# EasyEDA Pro project Chessboards.epro, board Diagonal (continued)
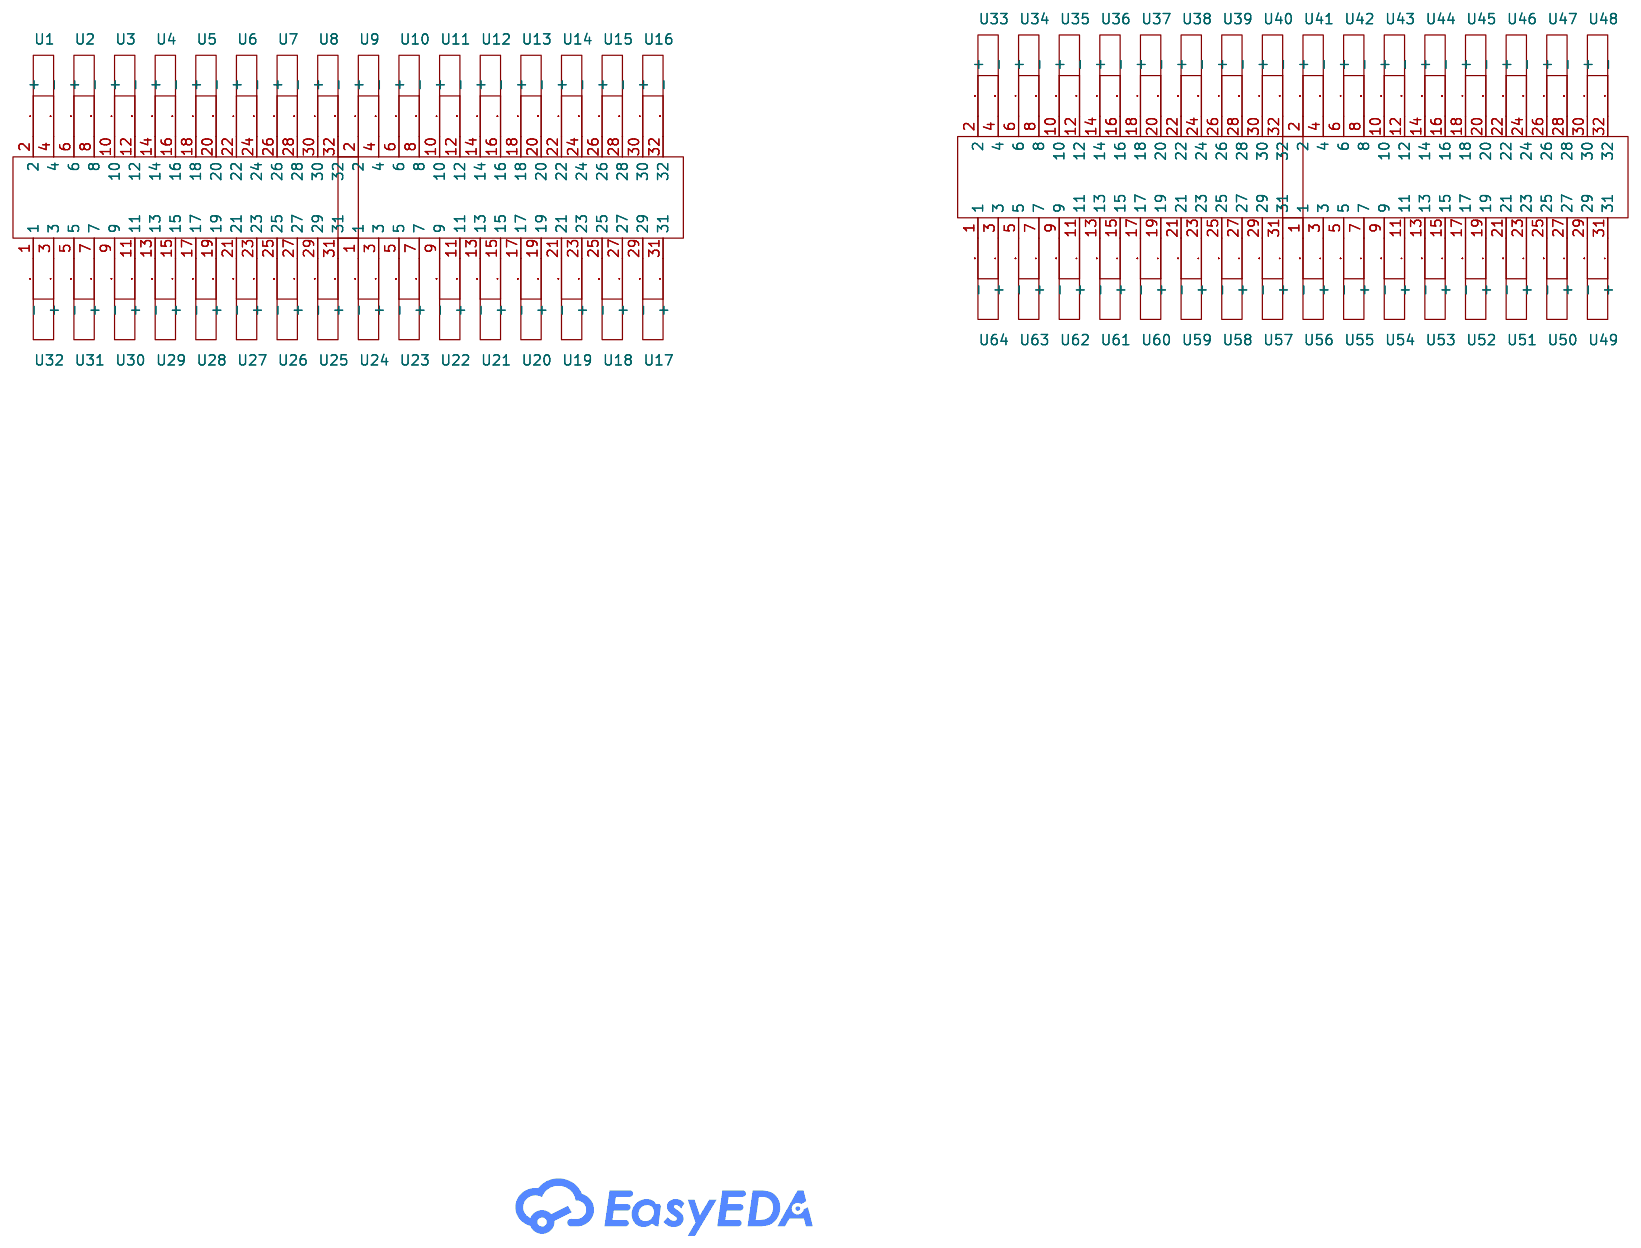
[diagram p0: schematic sheet]
## Routing (per net, layer and track width the routed paths; a pad name or vN(x,y) marks a point on that pad's centre or on a via; arc(x,y) is an arc through that point) (continued)

## Text on the board
Top Silkscreen Layer: D
